# EasyEDA Pro project hardware.eprj, schematic Schematic4
Create Date: 2022-12-13; Page Name: P1; Project Name: SCH_tc264_2022-07-02; Schematic Name: Schematic4; Update Date: 2022-12-15; Company: 嘉立创EDA; Page Size: A4; Version: V1.0
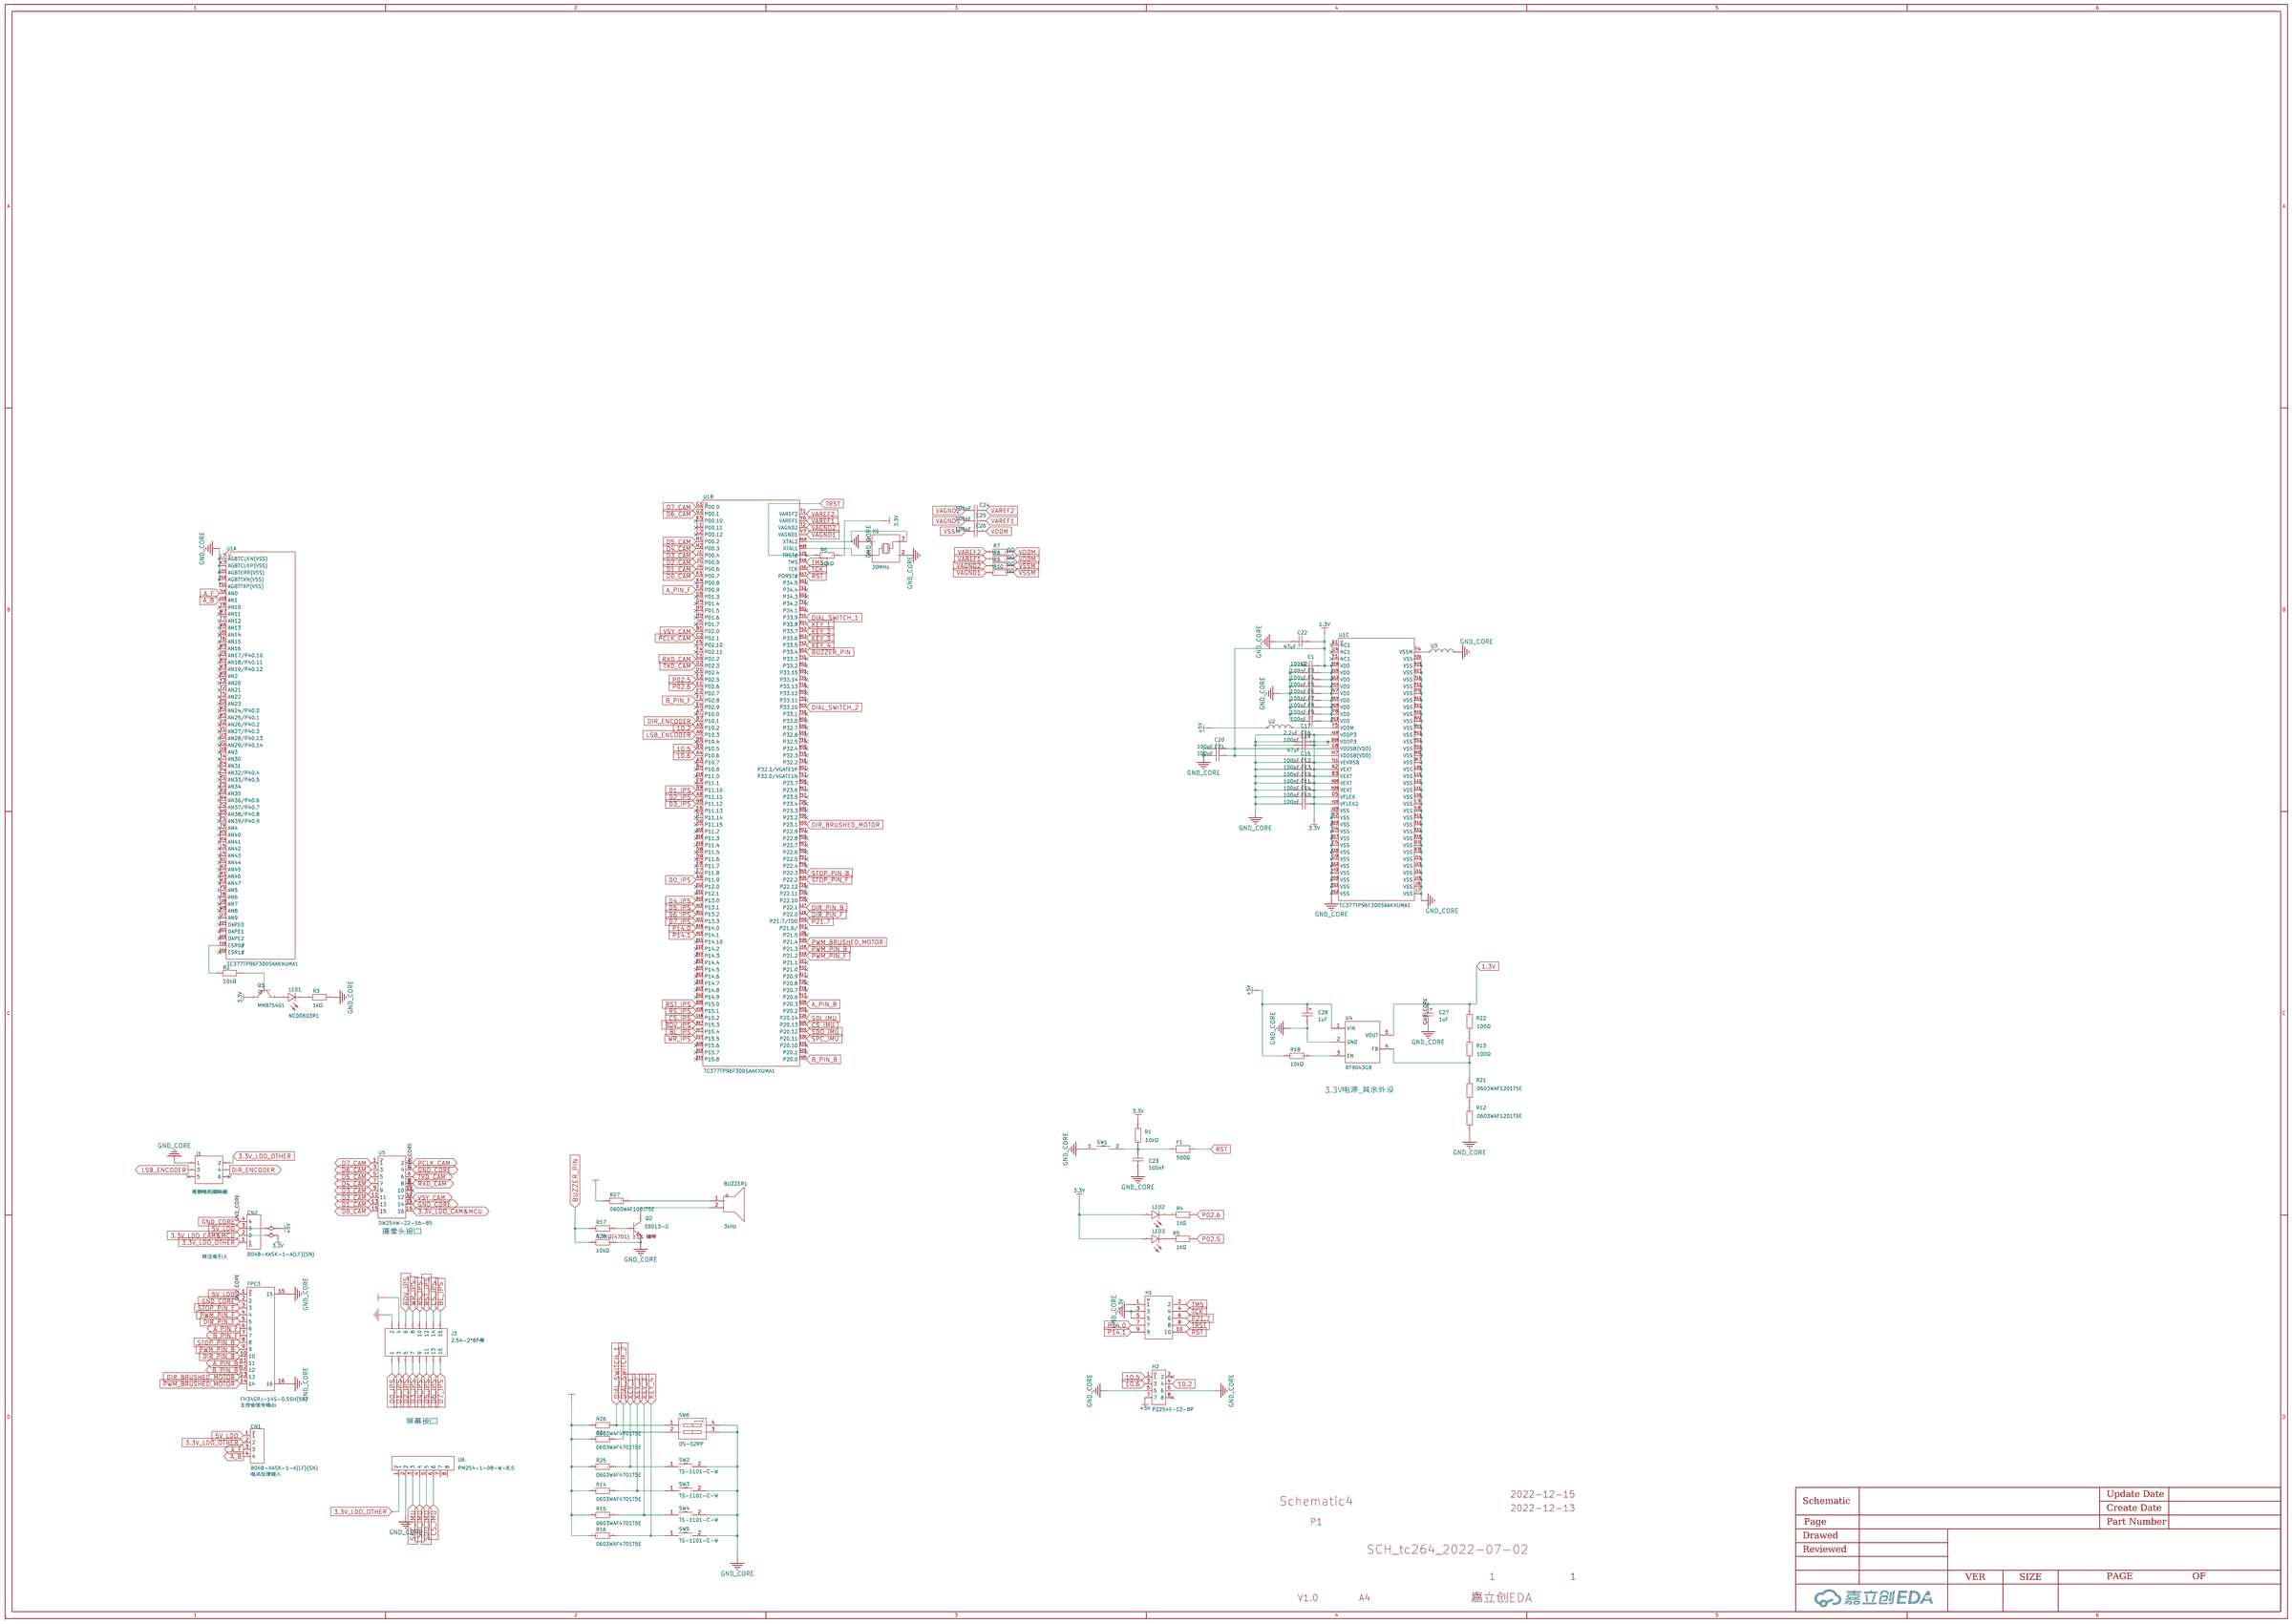
[diagram p4: schematic sheet]

## Parts
BUZZER1  3kHz  [BUZ-TH_BD9.0-P5.00-D0.6-FD]
C1  100nF  [C0402_NEW]
C2  100nF  [C0402_NEW]
C3  100nF  [C0402_NEW]
C4  100nF  [C0402_NEW]
C5  100nF  [C0402_NEW]
C6  100nF  [C0402_NEW]
C7  100nF  [C0402_NEW]
C8  100nF  [C0402_NEW]
C9  100nF  [C0402_NEW]
C10  100nF  [C0402_NEW]
C11  100nF  [C0402_NEW]
C12  100nF  [C0402_NEW]
C13  100nF  [C0402_NEW]
C14  100nF  [C0402_NEW]
C15  100nF  [C0402_NEW]
C16  100nF  [C0402_NEW]
C17  2.2uF  [C0603]
C18  47uF  [C0603]
C19  100nF  [C0402_NEW]
C20  100nF  [C0402_NEW]
C21  100nF  [C0402_NEW]
C22  47uF  [C0603]
C23  100nF  [C0402_NEW]
C24  100nF  [C0402_NEW]
C25  100nF  [C0402_NEW]
C26  100nF  [C0402_NEW]
C27  1uF  [CAP-SMD_L3.2-W1.6-RD]
C28  1uF  [CAP-SMD_L3.2-W1.6-RD]
CN1  B04B-XASK-1-A(LF)(SN)  [CONN-TH_B04B-XASK-1-A-LF-SN]
CN2  B04B-XASK-1-A(LF)(SN)  [CONN-TH_B04B-XASK-1-A-LF-SN]
F1  500Ω  [R0603]
FPC3  FH34SRJ-14S-0.5SH(50)  [FFC-SMD_14P-P0.50_FH34SRJ-14S-0.5SH]
H1  B-2100S10P-B110  [HDR-TH_10P-P2.54-V-M-R2-C5-S2.54]
H2  PZ254V-12-8P  [HDR-TH_8P-P2.54-V-M-R2-C4-S2.54]
J1  有刷电机编码器  [HDR-TH_6P-P2.54-V-M-R2-C3-S2.54-1]
J3  2.54-2*8P母  [HDR-TH_16P-P2.54-V-F-R2-C8-S2.54-1]
LED1  NCD0603R1  [LED0603-RD_RED]
LED2  NCD0603R1  [LED0603-RD_RED]
LED3  NCD0603R1  [LED0603-RD_RED]
Q1  MMBT5401  [SOT-23-3_L2.9-W1.3-P1.90-LS2.4-BR]
Q2  S9013-G  [SOT-23-3_L2.9-W1.3-P1.90-LS2.4-BR]
R1  10kΩ  [R0603]
R2  10kΩ  [R0603]
R3  1kΩ  [R0603]
R4  1kΩ  [R0603]
R5  1kΩ  [R0603]
R6  10kΩ  [R0603]
R7  0Ω  [R0603]
R8  0Ω  [R0603]
R9  0Ω  [R0603]
R10  0Ω  [R0603]
R12  0603WAF1201T5E  [R0603]
R13  100Ω  [R0603]
R14  0603WAF4701T5E  [R0603]
R15  0603WAF4701T5E  [R0603]
R16  0603WAF4701T5E  [R0603]
R17  0603WAF4701T5E  [R0603]
R18  10kΩ  [R0603]
R21  0603WAF1201T5E  [R0603]
R22  100Ω  [R0603]
R24  0603WAF4701T5E  [R0603]
R25  0603WAF4701T5E  [R0603]
R26  0603WAF4701T5E  [R0603]
R27  0603WAF100JT5E  [R0603]
R28  10kΩ  [R0603]
SW1  TS-1101-C-W  [SW-SMD_L6.0-W3.3-LS8.0]
SW2  TS-1101-C-W  [SW-SMD_L6.0-W3.3-LS8.0]
SW3  TS-1101-C-W  [SW-SMD_L6.0-W3.3-LS8.0]
SW4  TS-1101-C-W  [SW-SMD_L6.0-W3.3-LS8.0]
SW5  TS-1101-C-W  [SW-SMD_L6.0-W3.3-LS8.0]
SW6  DS-02RP  [SW-TH_DS-02XP]
U1  TC377TP96F300SAAKXUMA1  [PG-LFBGA-292_L17.0-W17.0-P0.80-BL_INFINEON_SAK-TC29XXXX]  (sections 1,2,3)
U2  CBM160808U501T  [L0603]
U3  CBM160808U501T  [L0603]
U4  RT9043GB  [SOT-23-5_L3.0-W1.7-P0.95-LS2.8-BR]
U5  DW254W-22-16-85  [HDR-TH_16P-P2.54-H-F-R2-C8-S2.54-W12.7-N]
U6  PM254-1-08-W-8.5  [HDR-TH_8P-P2.54-H-F-W10.0-N]
X1  20MHz  [OSC-SMD_4P-L3.2-W2.5-BL]

## Library data of the parts
BUZZER1 = HNB09A03: 驱动方式:电磁式;构造类型:有源;额定电压:3V;工作电压:1.5V~4.5V;消耗电流:30mA;频率:3kHz;声压(SPL):85dB@10cm;直径(φD):9mm;长度:-;宽度:-;高度:5.5mm;工作温度:-20~+70;; LCSC Part Name: 电磁式有源一体蜂鸣器HNB09A03; Supplier Part: C96102; Manufacturer: 华能; Supplier Footprint: 插件,P=5mm; JLCPCB Part Class: Extended Part; Datasheet: https://atta.szlcsc.com/upload/public/pdf/source/20170522/1495448326172.pdf; Supplier: LCSC; Oscillator Circuit: 电磁式; Technology Type: 有源; Rated Voltage: 3V; Operating Voltage: 1.5V~4.5V; Current Consumption: 30mA; Sound Pressure Level (SPL): 85dB@10cm; Diameter (φD): 9mm; Height: 5.5mm; Operating Temperature: -20~+70
C1-C16 C19-C21 C23-C26 = CL05B104KO5NNNC: 容值:100nF;精度:±10%;额定电压:16V;材质(温度系数):X7R;; LCSC Part Name: 100nF ±10% 16V; Supplier Part: C1525; Manufacturer: SAMSUNG(三星); Supplier Footprint: 0402; JLCPCB Part Class: Basic Part; Datasheet: https://atta.szlcsc.com/upload/public/pdf/source/20160103/1457707674891.pdf; Supplier: LCSC; Tolerance: ±10%; Voltage Rated: 16V; Temperature Coefficient: X7R
C17 = CL10A225KO8NNNC: 容值:2.2uF;精度:±10%;额定电压:16V;材质(温度系数):X5R;; LCSC Part Name: 2.2uF ±10% 16V; Supplier Part: C23630; Manufacturer: SAMSUNG(三星); Supplier Footprint: 0603; JLCPCB Part Class: Basic Part; Datasheet: https://atta.szlcsc.com/upload/public/pdf/source/20160103/1457707709512.pdf; Supplier: LCSC; Tolerance: ±10%; Voltage Rated: 16V; Temperature Coefficient: X5R
C18 C22 = GRM188R60J476ME15D: 容值:47uF;精度:±20%;额定电压:6.3V;材质(温度系数):X5R;; LCSC Part Name: 47uF ±20% 6.3V; Supplier Part: C140782; Manufacturer: muRata(村田); Supplier Footprint: 0603; JLCPCB Part Class: Extended Part; Datasheet: https://atta.szlcsc.com/upload/public/pdf/source/20171113/C140782_15105612981581115778.pdf; Supplier: LCSC; Tolerance: ±20%; Voltage Rated: 6.3V; Temperature Coefficient: X5R
C27 C28 = TAJA105K016RNJ: 容值:1uF;精度:±10%;额定电压:16V;等效串联电阻:-;工作温度:-55~+125;; LCSC Part Name: 1uF ±10% 16V; Supplier Part: C7174; Manufacturer: Kyocera AVX; Supplier Footprint: CASE-A_3216; JLCPCB Part Class: Extended Part; Datasheet: https://atta.szlcsc.com/upload/public/pdf/source/20160107/1457707748219.pdf; Supplier: LCSC; Tolerance: ±10%; Rated Voltage: 16V; Operating Temperature: -55~+125
CN1 CN2 = B04B-XASK-1-A(LF)(SN): 参考系列:XA;间距:2.5mm;插针结构:1x4P;排数:1;每排PIN数:4;行距:-;公母:公型插针;安装方式:直插;额定电流:3A;工作温度范围:-25~+85;; LCSC Part Name: 4P 脚距2.5mm; Supplier Part: C491709; Manufacturer: JST; Supplier Footprint: 插件,P=2.5mm; JLCPCB Part Class: Extended Part; Datasheet: https://atta.szlcsc.com/upload/public/pdf/source/20200416/C514162_2DCD7D1CD2019D14145B8FEA1B6236C2.pdf; Supplier: LCSC; Reference Series: XA; Pitch: 2.5mm; Pins Structure: 1x4P; Number of Rows: 1; Number of PINs Per Row: 4; Gender: 公型插针; Mounting Style: 直插; Current Rating (Max): 3A; Operating Temperature Range: -25~+85
F1 = RT0603BRC07500RL: 电阻类型:薄膜电阻;阻值:500Ω;精度:±0.1%;功率:100mW;温度系数:±15ppm/℃;工作温度范围:-55℃~+155℃;; LCSC Part Name: 500Ω ±0.1% 100mW; Supplier Part: C860931; Manufacturer: YAGEO(国巨); Supplier Footprint: 0603; JLCPCB Part Class: Extended Part; Datasheet: https://atta.szlcsc.comnull; Supplier: LCSC; Type: 薄膜电阻; Tolerance: ±0.1%; Power(Watts): 100mW; Temperature Coefficient: ±15ppm/℃; Operating Temperature Range: -55℃~+155℃
FPC3 = FH34SRJ-14S-0.5SH(50): 间距:0.5mm;触点数量:14;锁定特性:-;安装类型:卧贴;触点类型:双侧触点/上下接;; LCSC Part Name: 0.5mm P数:14 双侧触点/上下接; Supplier Part: C324724; Manufacturer: HRS(广濑); Supplier Footprint: SMD,P=0.5mm; JLCPCB Part Class: Extended Part; Datasheet: https://atta.szlcsc.com/upload/public/pdf/source/20181106/C324724_DC7CE3D3468642B05BE9C7F247386E31.pdf; Supplier: LCSC; Pitch: 0.5mm; Number of Contacts: 14; Mounting Type: 卧贴; Contact Type: 双侧触点/上下接; Height Above Board: 1mm; FFC, FCB Thickness: 0.3mm
H1 = B-2100S10P-B110: 间距:2.54mm;总PIN位数:10;排数:2;插针结构:2x5P;行距:2.54mm;安装类型:直插;圆针/方针:-;额定电流:-;额定电压:-;配合针长度:6mm;塑高:2.54mm;端接针长度:3mm;触头材质:黄铜;触头镀层:-;工作温度范围:-40℃~+105℃;颜色:黑色;; LCSC Part Name: 2.54mm 2x5P 直插; Supplier Part: C124387; Manufacturer: Ckmtw(灿科盟); Supplier Footprint: 直插,P=2.54mm; JLCPCB Part Class: Extended Part; Datasheet: https://atta.szlcsc.com/upload/public/pdf/source/20170821/C124387_1503303312729901541.pdf; Supplier: LCSC; Pitch: 2.54mm; Number of Pins: 10; Number of Rows: 2; Pin Structure: 2x5P; Row Spacing: 2.54mm; Mounting Type: 直插; Length of Mating Pin: 6mm; Insulation Height: 2.54mm; Length of End Connection Pin: 3mm; Contact Material: 黄铜; Operating Temperature Range: -40℃~+105℃; Color: 黑色
H2 = PZ254V-12-8P: 间距:2.54mm;总PIN位数:8;排数:2;插针结构:2x4P;行距:2.54mm;安装类型:直插;圆针/方针:方针;额定电流:-;额定电压:-;配合针长度:6mm;塑高:2.5mm;端接针长度:3mm;触头材质:黄铜;触头镀层:-;工作温度范围:-40℃~+105℃;颜色:黑色;; LCSC Part Name: 2.54mm 2x4P 直插 方针; Supplier Part: C492421; Manufacturer: XFCN(兴飞); Supplier Footprint: 直插,P=2.54mm; JLCPCB Part Class: Extended Part; Datasheet: https://atta.szlcsc.com/upload/public/pdf/source/20200309/C492421_DC8A206AF99CD7755BD4A5B0BC48200B.pdf; Supplier: LCSC; Pitch: 2.54mm; Number of Pins: 8; Number of Rows: 2; Pin Structure: 2x4P; Row Spacing: 2.54mm; Mounting Type: 直插; Circluar Pins/Square Pins: 方针; Length of Mating Pin: 6mm; Insulation Height: 2.5mm; Length of End Connection Pin: 3mm; Contact Material: 黄铜; Operating Temperature Range: -40℃~+105℃; Color: 黑色
J1 = 2.54-2*3P针: 间距:2.54mm;总PIN位数:6;排数:2;插针结构:-;行距:-;安装类型:直插;圆针/方针:-;额定电流:-;额定电压:-;配合针长度:-;塑高:-;触头材质:-;触头镀层:-;颜色:黑色;; LCSC Part Name: 2.54mm 直插; Supplier Part: C65114; Manufacturer: BOOMELE(博穆精密); Supplier Footprint: 直插,P=2.54mm; JLCPCB Part Class: Extended Part; Datasheet: https://atta.szlcsc.comnull; Supplier: LCSC; Pitch: 2.54mm; Number of Pins: 6; Number of Rows: 2; Mounting Type: 直插; Color: 黑色
J3 = 2.54-2*8P母: 间距:2.54mm;总孔位数:16;排数:2;插孔结构:2x8P;行距:2.54mm;安装类型:直插;塑高:-;触头材质:黄铜;触头镀层:-;; LCSC Part Name: 2.54mm 2x8P; Supplier Part: C30734; Manufacturer: BOOMELE(博穆精密); Supplier Footprint: 直插,P=2.54mm; JLCPCB Part Class: Extended Part; Datasheet: https://atta.szlcsc.com/upload/public/pdf/source/20151109/1457707555924.pdf; Supplier: LCSC; Pitch: 2.54mm; Number of Holes: 16; Number of Rows: 2; Holes Structure: 2x8P; Row Spacing: 2.54mm; Mounting Type: 直插; Contact Material: 黄铜
LED1-LED3 = NCD0603R1_C84263: 发光颜色:红灯;; LCSC Part Name: 红灯; Supplier Part: C84263; Manufacturer: 国星光电; Supplier Footprint: 0603; JLCPCB Part Class: Extended Part; Datasheet: https://atta.szlcsc.com/upload/public/pdf/source/20200820/C84263_DABC6A75E58F576973B407FDBA283D60.pdf; Supplier: LCSC; Emitted Color: 红灯
Q1 = MMBT5401_C8326: 晶体管类型:PNP;集射极击穿电压(Vceo):150V;集电极电流(Ic):600mA;功率(Pd):300mW;集电极截止电流(Icbo):100nA;集电极-发射极饱和电压(VCE(sat)@Ic,Ib):500mV@50mA,5mA;直流电流增益(hFE@Ic,Vce):200@10mA,5V;特征频率(fT):100MHz;工作温度:+150℃@(Tj);; LCSC Part Name: PNP 150V 600mA; Supplier Part: C8326; Manufacturer: CJ(江苏长电/长晶); Supplier Footprint: SOT-23-3; JLCPCB Part Class: Basic Part; Datasheet: https://atta.szlcsc.com/upload/public/pdf/source/20140809/1457707213644.pdf; Supplier: LCSC; Transistor Type: PNP; Collector-Emitter Breakdown Voltage (Vceo): 150V; Collector Current (Ic): 600mA; Power Dissipation (Pd): 300mW; Collector Cut-Off Current (Icbo): 100nA; Collector-Emitter Saturation Voltage (VCE(sat)@Ic,Ib): 500mV@50mA,5mA; DC Current Gain (hFE@Ic,Vce): 200@10mA,5V; Transition Frequency (fT): 100MHz; Operating Temperature: +150℃@(Tj)
Q2 = S9013-G: 晶体管类型:NPN;集射极击穿电压(Vceo):25V;集电极电流(Ic):500mA;功率(Pd):300mW;; LCSC Part Name: S9013 H档(200-350) H档(200-350); Supplier Part: C164888; Manufacturer: CJ(江苏长电/长晶); Supplier Footprint: SOT-23(SOT-23-3); JLCPCB Part Class: Extended Part; Datasheet: https://atta.szlcsc.com/upload/public/pdf/source/20171228/C164888_15144412896081213891.pdf; Supplier: LCSC; Transistor Type: NPN; Collector-Emitter Breakdown Voltage (Vceo): 25V; Collector Current (Ic): 500mA; Power Dissipation (Pd): 300mW
R1 R2 R6 = 0603WAF1002T5E: 电阻类型:厚膜电阻;阻值:10kΩ;精度:±1%;功率:100mW;温度系数:±100ppm/℃;最大工作电压:75V;工作温度范围:-55℃~+155℃;; LCSC Part Name: 10kΩ ±1% 100mW; Supplier Part: C25804; Manufacturer: UNI-ROYAL(厚声); Supplier Footprint: 0603; JLCPCB Part Class: Basic Part; Datasheet: https://atta.szlcsc.com/upload/public/pdf/source/20200306/C422600_1E6D84923E4A46A82E41ADD87F860B5C.pdf; Supplier: LCSC; Type: 厚膜电阻; Tolerance: ±1%; Power(Watts): 100mW; Temperature Coefficient: ±100ppm/℃; Overload Voltage (Max): 75V; Operating Temperature Range: -55℃~+155℃
R3-R5 = 0603WAF1001T5E: 电阻类型:厚膜电阻;阻值:1kΩ;精度:±1%;功率:100mW;温度系数:±100ppm/℃;最大工作电压:75V;工作温度范围:-55℃~+155℃;; LCSC Part Name: 1kΩ ±1% 100mW; Supplier Part: C21190; Manufacturer: UNI-ROYAL(厚声); Supplier Footprint: 0603; JLCPCB Part Class: Basic Part; Datasheet: https://atta.szlcsc.com/upload/public/pdf/source/20200306/C422600_1E6D84923E4A46A82E41ADD87F860B5C.pdf; Supplier: LCSC; Type: 厚膜电阻; Tolerance: ±1%; Power(Watts): 100mW; Temperature Coefficient: ±100ppm/℃; Overload Voltage (Max): 75V; Operating Temperature Range: -55℃~+155℃
R7-R10 = 0603WAJ0000T5E: 电阻类型:厚膜电阻;阻值:0Ω;精度:±5%;功率:100mW;温度系数:±800ppm/℃;最大工作电压:75V;工作温度范围:-55℃~+155℃;; LCSC Part Name: 0Ω ±5% 100mW; Supplier Part: C15402; Manufacturer: UNI-ROYAL(厚声); Supplier Footprint: 0603; JLCPCB Part Class: Extended Part; Datasheet: https://atta.szlcsc.com/upload/public/pdf/source/20200306/C422600_1E6D84923E4A46A82E41ADD87F860B5C.pdf; Supplier: LCSC; Type: 厚膜电阻; Tolerance: ±5%; Power(Watts): 100mW; Temperature Coefficient: ±800ppm/℃; Overload Voltage (Max): 75V; Operating Temperature Range: -55℃~+155℃
R12 R21 = 0603WAF1201T5E: LCSC Part Name: 1.2KΩ(1201) ±1% 编带; Supplier Part: C22765; Manufacturer: UNI-ROYAL(厚声); Supplier Footprint: 0603; JLCPCB Part Class: Basic Part; Datasheet: https://atta.szlcsc.com/upload/public/pdf/source/20170920/C22765_1505887453653980563.pdf; Supplier: LCSC
R13 R22 = RC0603FR-07100RL: 电阻类型:厚膜电阻;阻值:100Ω;精度:±1%;功率:100mW;温度系数:±100ppm/℃;最大工作电压:75V;工作温度范围:-55℃~+155℃;; LCSC Part Name: 100Ω ±1%; Supplier Part: C105588; Manufacturer: YAGEO(国巨); Supplier Footprint: 0603; JLCPCB Part Class: Extended Part; Datasheet: https://atta.szlcsc.com/upload/public/pdf/source/20170428/1493376742308.pdf; Supplier: LCSC; Type: 厚膜电阻; Tolerance: ±1%; Power(Watts): 100mW; Temperature Coefficient: ±100ppm/℃; Overload Voltage (Max): 75V; Operating Temperature Range: -55℃~+155℃
R14-R17 R24-R26 = 0603WAF4701T5E: LCSC Part Name: 4.7KΩ(4701) ±1% 编带; Supplier Part: C23162; Manufacturer: UNI-ROYAL(厚声); Supplier Footprint: 0603; JLCPCB Part Class: Basic Part; Datasheet: https://atta.szlcsc.com/upload/public/pdf/source/20170920/C23162_1505901109673982545.pdf; Supplier: LCSC
R18 R28 = 0603WAF1002T5E: 电阻类型:厚膜电阻;阻值:10kΩ;精度:±1%;功率:100mW;温度系数:±100ppm/;最大工作电压:75V;工作温度范围:-55~+155;; LCSC Part Name: 10kΩ ±1% 100mW; Supplier Part: C25804; Manufacturer: UNI-ROYAL(厚声); Supplier Footprint: 0603; JLCPCB Part Class: Basic Part; Datasheet: https://atta.szlcsc.com/upload/public/pdf/source/20200306/C422600_1E6D84923E4A46A82E41ADD87F860B5C.pdf; Supplier: LCSC; Type: 厚膜电阻; Tolerance: ±1%; Power(Watts): 100mW; Temperature Coefficient: ±100ppm/; Overload Voltage (Max): 75V; Operating Temperature Range: -55~+155
R27 = 0603WAF100JT5E: LCSC Part Name: 10Ω(10R0) ±1% 编带; Supplier Part: C22859; Manufacturer: UNI-ROYAL(厚声); Supplier Footprint: 0603; JLCPCB Part Class: Basic Part; Datasheet: https://atta.szlcsc.com/upload/public/pdf/source/20170920/C22859_1505900954295982249.pdf; Supplier: LCSC
SW1 = TS-1101-C-W: 触点电流:50mA;额定电压(DC):12V;绝缘电阻:100mΩ;电路结构:单刀单掷;安装方式:立贴;按钮形状:矩形按钮;按钮/盖帽颜色:白色;带灯:无;作用力:260gf;机械寿命:50000;工作温度:-30℃~+85℃;开关长度:6mm;开关宽度:3.6mm;开关高度:2.5mm;带支架:否;; LCSC Part Name: TS-1101-C-W 一型3*6*2.5有白ZD b拉伸白色按键 卷装; Supplier Part: C318938; Manufacturer: XKB Connectivity(中国星坤); Supplier Footprint: SMD; JLCPCB Part Class: Extended Part; Datasheet: https://atta.szlcsc.com/upload/public/pdf/source/20200227/C318938_C2E53B1EEDE37D980A33616AC086DE53.pdf; Supplier: LCSC; Contact Current: 50mA; Voltage Rating (DC): 12V; Insulation Resistance: 100mΩ; Circuit: 单刀单掷; Mounting Style: 立贴; Actuator Style: 矩形按钮; Actuator/Cap Color: 白色; With Lamp: 无; Operating Force: 260gf; Mechanical Life: 50000; Operating Temperature: -30℃~+85℃; Switch Length: 6mm; Switch Width: 3.6mm; Switch Height: 2.5mm; Strike Gundam: 否
SW2-SW5 = TS-1101-C-W: 触点电流:50mA;额定电压(DC):12V;绝缘电阻:100mΩ;电路结构:单刀单掷;安装方式:立贴;按钮形状:矩形按钮;按钮/盖帽颜色:白色;带灯:无;作用力:260gf;机械寿命:50000;工作温度:-30~+85;开关长度:6mm;开关宽度:3.6mm;开关高度:2.5mm;带支架:否;; LCSC Part Name: TS-1101-C-W 一型3*6*2.5有白ZD b拉伸白色按键 卷装; Supplier Part: C318938; Manufacturer: XKB Connectivity(中国星坤); Supplier Footprint: SMD; JLCPCB Part Class: Extended Part; Datasheet: https://atta.szlcsc.com/upload/public/pdf/source/20200227/C318938_C2E53B1EEDE37D980A33616AC086DE53.pdf; Supplier: LCSC; Contact Current: 50mA; Voltage Rating (DC): 12V; Insulation Resistance: 100mΩ; Circuit: 单刀单掷; Mounting Style: 立贴; Actuator Style: 矩形按钮; Actuator/Cap Color: 白色; With Lamp: 无; Operating Force: 260gf; Mechanical Life: 50000; Operating Temperature: -30~+85; Switch Length: 6mm; Switch Width: 3.6mm; Switch Height: 2.5mm; Strike Gundam: 否
SW6 = DS-02RP: 类型:平拨，凸起式;额定电流:25mA;额定电压:24V;电路结构:单刀单掷;开关位数:2;引脚间距:2.54mm;工作温度:-20~+70;使用寿命:3000;颜色:红色;; LCSC Part Name: 红色2PIN-2.54mm立式直插正拨拨码开关; Supplier Part: C92646; Manufacturer: 韩国韩荣; Supplier Footprint: 插件; JLCPCB Part Class: Extended Part; Datasheet: https://atta.szlcsc.com/upload/public/pdf/source/20210810/ECF2F28B1CE673E7F9581E27682BDB10.pdf; Supplier: LCSC; Type: 平拨，凸起式; Current Rating: 25mA; Voltage Rating: 24V; Circuit: 单刀单掷; Number of Positions: 2; Lead Pitch: 2.54mm; Operating Temperature: -20~+70; Operating Life: 3000; Color: 红色
U1 = TC377TP96F300SAAKXUMA1: Supplier Part: C3232089; Manufacturer: Infineon(英飞凌); Supplier Footprint: PG-LFBGA-292-6; Datasheet: https://atta.szlcsc.comnull; Supplier: LCSC
U2 U3 = CBM160808U501T: 标称阻抗@测试频率:500Ω@100MHz;误差:±25%;直流电阻(RDC):180mΩ;额定电流:1.2A;电路数:1;; LCSC Part Name: 500Ω@100MHz ±25%; Supplier Part: C316451; Manufacturer: FH(风华); Supplier Footprint: 0603; JLCPCB Part Class: Extended Part; Datasheet: https://atta.szlcsc.com/upload/public/pdf/source/20181211/C316451_DBF3079B2B53D5C89DC535D7CFA82CCE.pdf; Supplier: LCSC; Impedance @ Frequency: 500Ω@100MHz; Tolerance: ±25%; DC Resistance: 180mΩ; Current Rating: 1.2A; Circuits: 1
U4 = RT9043GB: 输出类型:可调;输出极性:正;输出通道数:1;最大输入电压:5.5V;输出电压:1.2V~5V;压差:350mV@(400mA);输出电流:400mA;电源纹波抑制比(PRSS):67dB@(1kHz),56dB@(10kHz);; LCSC Part Name: Vin=5.5V Vout=1.2V~5V 400mA 67dB@(1kHz),56dB@(10kHz); Supplier Part: C55019; Manufacturer: RICHTEK(台湾立锜); Supplier Footprint: SOT-23-5; JLCPCB Part Class: Extended Part; Datasheet: https://atta.szlcsc.com/upload/public/pdf/source/20150811/1457707342352.pdf; Supplier: LCSC; Output Type: 可调; Output Polarity: 正; Number of Outputs: 1; Maximum Input Voltage: 5.5V; Output Voltage: 1.2V~5V; Dropout Voltage: 350mV@(400mA); Output Current: 400mA; Power Supply Rejection Ratio (PRSS): 67dB@(1kHz),56dB@(10kHz)
U5 = DW254W-22-16-85: 间距:2.54mm;总孔位数:16;排数:2;插孔结构:2x8P;行距:2.54mm;安装类型:弯插;圆孔/方孔:方孔;额定电流:3A;额定电压:-;插孔方向:侧面;塑高:8.5mm;工作温度范围:-;; LCSC Part Name: 2.54mm 2x8P; Supplier Part: C2936005; Manufacturer: DEALON(德艺隆); Supplier Footprint: 弯插,P=2.54mm; JLCPCB Part Class: Extended Part; Datasheet: https://atta.szlcsc.com/upload/public/pdf/source/20211231/D29517537FCFFABF14C4453E96D14918.pdf; Supplier: LCSC; Pitch: 2.54mm; Number of Holes: 16; Number of Rows: 2; Holes Structure: 2x8P; Row Spacing: 2.54mm; Mounting Type: 弯插; Circular Hole / Square Hole: 方孔; Current Rating (Max): 3A; Holes Direction: 侧面; Insulation Height: 8.5mm
U6 = PM254-1-08-W-8.5: 间距:2.54mm;总孔位数:8;排数:1;插孔结构:1x8P;行距:-;安装类型:弯插;圆孔/方孔:方孔;额定电流:3A;额定电压:-;插孔方向:侧面;塑高:8.5mm;工作温度范围:-40℃~+105℃;; LCSC Part Name: 2.54mm 1x8P; Supplier Part: C2897390; Manufacturer: HCTL(华灿天禄); Supplier Footprint: 弯插,P=2.54mm; JLCPCB Part Class: Extended Part; Datasheet: https://atta.szlcsc.com/upload/public/pdf/source/20211019/10E5F374A8C70BEE256048F5DCDE14A3.pdf; Supplier: LCSC; Pitch: 2.54mm; Number of Holes: 8; Number of Rows: 1; Holes Structure: 1x8P; Mounting Type: 弯插; Circular Hole / Square Hole: 方孔; Current Rating (Max): 3A; Holes Direction: 侧面; Insulation Height: 8.5mm; Operating Temperature Range: -40℃~+105℃
X1 = X322520MSB4SI: 晶振类型:贴片无源晶振;频率:20MHz;频率公差:±10ppm;频率稳定度:±30ppm;负载电容:20pF;工作温度:-40℃~+85℃;; LCSC Part Name: YSX321SL 20MHz ±10ppm 20pF; Supplier Part: C9004; Manufacturer: YXC(扬兴晶振); Supplier Footprint: SMD3225-4P; JLCPCB Part Class: Extended Part; Datasheet: https://atta.szlcsc.com/upload/public/pdf/source/20210329/C112971_1F611BDC486E193C1706F6D8EB5AA189.pdf; Supplier: LCSC; Crystal Type: 贴片无源晶振; Frequency Tolerance: ±10ppm; Frequency Stability: ±30ppm; Load Capacitance: 20pF; Operating Temperature: -40℃~+85℃

## Nets
1.3V: C1.2 C2.2 C3.2 C4.2 C5.2 C6.2 C7.2 C8.2 C9.2 C20.2 C21.2 C22.2 C27.1 R22.2 U1.D16(VDD) U1.E15(VDD) U1.G8(VDDSB(VDD)) U1.G13(VDD) U1.H7(VDDSB(VDD)) U1.H14(VDD) U1.N7(VDD) U1.N14(VDD) U1.N19(VDD) U1.P8(VDD) U1.P13(VDD) U4.5(VOUT)
3.3V: C10.2 C11.2 C12.2 C13.2 C14.2 C15.2 C16.2 C17.2 C18.2 C19.2 CN2.2 H1.1 LED2.2(A) LED3.2(A) Q1.2(E) R1.2 R6.1 U1.A2(VEXT) U1.A19(VDDP3) U1.B3(VEXT) U1.B18(VDDP3) U1.D5(VFLEX) U1.N20(VEXT) U1.T11(VEVRSB) U1.V19(VFLEX2) U1.W20(VEXT) U5.16
3.3V_LDO_OTHER: CN1.2 CN2.1 J1.2 J3.4 R14.1 R15.1 R16.1 R24.1 R25.1 R26.1 R27.1 U6.1
+5V: C28.1 CN1.1 CN2.3 FPC3.1 H2.7 R18.1 U2.1 U4.1(VIN)
GND_CORE: C1.1 C2.1 C3.1 C4.1 C5.1 C6.1 C7.1 C8.1 C9.1 C10.1 C11.1 C12.1 C13.1 C14.1 C15.1 C16.1 C17.1 C18.1 C19.1 C20.1 C21.1 C22.1 C23.1 C27.2 C28.2 CN2.4 FPC3.2 FPC3.15 FPC3.16 H1.3 H1.5 H2.5 H2.6 J1.1 J3.2 Q2.2(E) R3.2 R12.1 R28.2 SW1.1 SW2.2 SW3.2 SW4.2 SW5.2 SW6.3 SW6.4 U1.A20(VSS) U1.B2(VSS) U1.B19(VSS) U1.D4(VSS) U1.D17(VSS) U1.E5(VSS) U1.E16(VSS) U1.G9(VSS) U1.G12(VSS) U1.H9(VSS) U1.H10(VSS) U1.H11(VSS) U1.H12(VSS) U1.J7(VSS) U1.J8(VSS) U1.J10(VSS) U1.J11(VSS) U1.J13(VSS) U1.J14(VSS) U1.K7(AGBTCLKP(VSS)) U1.K8(VSS) U1.K9(VSS) U1.K10(VSS) U1.K11(VSS) U1.K12(VSS) U1.K13(VSS) U1.L7(AGBTCLKN(VSS)) U1.L8(VSS) U1.L9(VSS) U1.L10(VSS) U1.L11(VSS) U1.L12(VSS) U1.L13(VSS) U1.L14(AGBTERR(VSS)) U1.L20(VSS) U1.M7(VSS) U1.M8(VSS) U1.M10(VSS) U1.M11(VSS) U1.M13(VSS) U1.M14(VSS) U1.N9(VSS) U1.N10(VSS) U1.N11(VSS) U1.N12(VSS) U1.P9(VSS) U1.P10(AGBTTXN(VSS)) U1.P11(AGBTTXP(VSS)) U1.P12(VSS) U1.T16(VSS) U1.U17(VSS) U1.W19(VSS) U1.Y20(VSS) U3.2 U4.2(GND) U5.4 U5.14 U6.2 X1.2(GND) X1.4(GND)
VDDM: C26.2 R7.2 R8.2
VSSM: C26.1 R9.2 R10.2
10.2: H2.4 U1.A5(P10.2)
10.5: H2.1 U1.B5(P10.5)
10.6: H2.3 U1.A4(P10.6)
A_B: CN1.4 U1.U10(AN1)
A_F: CN1.3 U1.T10(AN0)
A_PIN_B: FPC3.11 U1.G20(P20.3)
A_PIN_F: FPC3.6 U1.K2(P00.9)
B_PIN_B: FPC3.12 U1.H20(P20.0)
B_PIN_F: FPC3.7 U1.F1(P02.8)
BL_IPS: J3.16 U1.A17(P15.4)
BUZZER_PIN: R17.1 R28.1 U1.W12(P33.4)
CS_IMU: U1.D20(P20.13) U6.6
CS_IPS: J3.14 U1.C19(P15.2)
D0_CAM: U1.K1(P00.7) U5.15
D0_IPS: J3.1 U1.A9(P11.9)
D1_CAM: U1.J4(P00.6) U5.13
D1_IPS: J3.3 U1.B9(P11.10)
D2_CAM: U1.J2(P00.5) U5.11
D2_IPS: J3.5 U1.A8(P11.11)
D3_CAM: U1.J1(P00.4) U5.9
D3_IPS: J3.7 U1.B8(P11.12)
D4_CAM: U1.H2(P00.3) U5.7
D4_IPS: J3.9 U1.B12(P13.0)
D5_CAM: U1.H1(P00.2) U5.5
D5_IPS: J3.11 U1.A12(P13.1)
D6_CAM: U1.G2(P00.1) U5.3
D6_IPS: J3.13 U1.B11(P13.2)
D7_CAM: U1.G1(P00.0) U5.1
D7_IPS: J3.15 U1.A11(P13.3)
DIAL_SWITCH_1: R26.2 SW6.1(A1) U1.Y14(P33.9)
DIAL_SWITCH_2: R24.2 SW6.2(A2) U1.W15(P33.10)
DIR_BRUSHED_MOTOR: FPC3.13 U1.U19(P23.1)
DIR_ENCODER: J1.4 U1.B7(P10.1)
DIR_PIN_B: FPC3.10 U1.L17(P22.1)
DIR_PIN_F: FPC3.5 U1.L16(P22.0)
KEY_1: R25.2 SW2.1 U1.W14(P33.8)
KEY_2: R14.2 SW3.1 U1.Y13(P33.7)
KEY_3: R15.2 SW4.1 U1.W13(P33.6)
KEY_4: R16.2 SW5.1 U1.Y12(P33.5)
LSB_ENCODER: J1.3 U1.A6(P10.3)
P02.5: R5.2 U1.E2(P02.5)
P02.6: R4.2 U1.E1(P02.6)
P14.0: H1.7 U1.B16(P14.0)
P14.1: H1.9 U1.A15(P14.1)
P21.7: H1.6 U1.H16(P21.7/TDO)
PCLK_CAM: U1.C2(P02.1) U5.2
PWM_BRUSHED_MOTOR: FPC3.14 U1.K20(P21.4)
PWM_PIN_B: FPC3.9 U1.J19(P21.3)
PWM_PIN_F: FPC3.4 U1.K19(P21.2)
RDV_IPS: J3.6 U1.B17(P15.3)
RS_IPS: J3.10 U1.A18(P15.1)
RST: F1.2 H1.10 U1.G17(PORST#)
RST_IPS: J3.12 U1.B20(P15.0)
RXD_CAM: U1.C1(P02.2) U5.8
SDI_IMU: U1.C20(P20.14) U6.4
SDO_IMU: U1.D19(P20.12) U6.5
SPC_IMU: U1.E20(P20.11) U6.3
STOP_PIN_B: FPC3.8 U1.R19(P22.3)
STOP_PIN_F: FPC3.3 U1.R20(P22.2)
TCK: H1.4 U1.J16(TCK)
TMS: H1.2 U1.K16(TMS)
TRST: H1.8 R6.2 U1.L19(TRST#)
TXD_CAM: U1.D2(P02.3) U5.6
VAGND1: C25.1 R10.1 U1.Y7(VAGND1)
VAGND2: C24.1 R9.1 U1.T2(VAGND2)
VAREF1: C25.2 R8.1 U1.Y6(VAREF1)
VAREF2: C24.2 R7.1 U1.T1(VAREF2)
VSY_CAM: U1.B1(P02.0) U5.12
WR_IPS: J3.8 U1.E14(P15.5)
$1N8110: U1.Y5(VDDM) U2.2
$1N13696: U1.Y4(VSSM) U3.1
$1N19046: U1.M20(XTAL1) X1.1(OSC1)
$1N19138: U1.M19(XTAL2) X1.3(OSC2)
$1N20625: C23.2 F1.1 R1.1 SW1.2
$1N21968: R2.2 U1.F16(ESR0#)
$1N22258: Q1.1(B) R2.1
$1N22786: LED1.2(A) Q1.3(C)
$1N22985: LED1.1(K) R3.1
$1N24704: LED2.1(K) R4.1
$1N24842: LED3.1(K) R5.1
$1N51401: R13.1 R21.2 U4.4(FB)
$1N51402: R18.2 U4.3(EN)
$1N52439: R12.2 R21.1
$1N53632: R13.2 R22.1
$1N56900: Q2.1(B) R17.2
$1N56902: BUZZER1.1(+) R27.2
$1N56903: BUZZER1.2(-) Q2.3(C)

Not connected (* = marked no-connect by the designer): H2 2* 8*; J1 5* 6*; U1 A1(NC1)* A3(P10.7)* A7(P10.0)* A10(P11.2)* A13(P14.8)* A14(P14.5)* A16(P15.6)* B4(P10.8)* B6(P10.4)* B10(P11.3)* B13(P14.6)* B14(P14.3)* B15(P14.4)* D1(P02.4)* D6(P11.15)* D7(P11.14)* D8(P11.5)* D9(P11.6)* D10(P11.4)* D11(P14.10)* D12(P14.9)* D13(P14.7)* D14(P15.8)* D15(P15.7)* E4(P02.9)* E6(P11.13)* E7(P11.8)* E8(P11.7)* E9(P11.1)* E10(P11.0)* E11(P12.1)* E12(P12.0)* E13(P14.2)* E17(P20.9)* E19(P20.10)* F2(P02.7)* F4(P02.11)* F5(P02.10)* F17(P20.6)* F19(P20.7)* F20(P20.8)* G4(P01.4)* G5(P01.3)* G10(DAPE2)* G11(DAPE1)* G16(ESR1#)* G19(P20.1)* H4(P01.6)* H5(P01.5)* H17(P21.6/)* H19(P20.2)* J5(P01.7)* J17(P21.1)* J20(P21.5)* K4(P00.8)* K5(P00.10)* K14(DAPE0)* K17(P21.0)* L1(P00.11)* L2(P00.12)* L4(AN43)* L5(AN42)* M1(AN46)* M2(AN47)* M4(AN41)* M5(AN40)* M16(P22.8)* M17(P22.9)* N1(AN44)* N2(AN45)* N4(AN36/P40.6)* N5(AN38/P40.8)* N16(P22.6)* N17(P22.7)* P1(AN39/P40.9)* P2(AN37/P40.7)* P4(AN32/P40.4)* P5(AN34)* P16(P22.4)* P17(P22.5)* P19(P22.11)* P20(P22.10)* R1(AN33/P40.5)* R2(AN35)* R4(AN31)* R5(AN23)* R16(P23.7)* R17(P23.6)* T4(AN30)* T5(AN22)* T6(AN15)* T7(AN12)* T8(AN6)* T9(AN4)* T12(P34.2)* T13(P34.4)* T14(P33.14)* T15(P32.5)* T17(P23.5)* T19(P22.12)* T20(P23.4)* U1(AN29/P40.14)* U2(AN28/P40.13)* U4(NC1)* U5(AN17/P40.10)* U6(AN14)* U7(AN9)* U8(AN7)* U9(AN3)* U11(P34.1)* U12(P34.3)* U13(P34.5)* U14(P33.15)* U15(P32.6)* U16(P32.7)* U20(P23.3)* V1(AN27/P40.3)* V2(AN26/P40.2)* V20(P23.2)* W1(AN25/P40.1)* W2(AN24/P40.0)* W3(AN19/P40.12)* W4(AN18/P40.11)* W5(AN16)* W6(AN13)* W7(AN11)* W8(AN8)* W9(AN2)* W10(P33.0)* W11(P33.2)* W16(P33.12)* W17(P32.1/VGATE1P)* W18(P32.4)* Y1(NC1)* Y2(AN21)* Y3(AN20)* Y8(AN10)* Y9(AN5)* Y10(P33.1)* Y11(P33.3)* Y15(P33.11)* Y16(P33.13)* Y17(P32.0/VGATE1N)* Y18(P32.2)* Y19(P32.3)*; U5 10*; U6 7 8

## Notes on the sheet
- 3.3V电源_其余外设
- 摄像头接口
- 降压板引入
- 主控板信号输出
- 屏幕接口
- 电流反馈输入
